# EAGLE schematic Resistor_Resistor (EAGLE 8.3.0), part 40 of 43
## Nets (continued)
N$160: R30001.2 R30002.2 R30003.2 R30004.2 R30005.2 R30006.2 R30007.2 R30008.2 R30009.2 R30010.2 R30011.2 R30012.2 R30013.2 R30014.2 R30015.2 R30016.2 R30017.2 R30018.2 R30019.2 R30020.2 R30021.2 R30022.2 R30023.2 R30024.2 R30025.2 R30026.2 R30027.2 R30028.2 R30029.2 R30030.2 R30031.2 R30032.2 R30033.2 R30034.2 R30035.2 R30036.2 R30037.2 R30038.2 R30039.2 R30040.2 R30041.2 R30042.2 R30043.2 R30044.2 R30045.2 R30046.2 R30047.2 R30048.2 R30049.2 R30050.2 R30051.2 R30052.2 R30053.2 R30054.2 R30055.2 R30056.2 R30057.2 R30058.2 R30059.2 R30060.2 R30061.2 R30062.2 R30063.2 R30064.2 R30065.2 R30066.2 R30067.2 R30068.2 R30069.2 R30070.2 R30071.2 R30072.2 R30073.2 R30074.2 R30075.2 R30076.2 R30077.2 R30078.2 R30079.2 R30080.2 R30081.2 R30082.2 R30083.2 R30084.2 R30085.2 R30086.2 R30087.2 R30088.2 R30089.2 R30090.2 R30091.2 R30092.2 R30093.2 R30094.2 R30095.2 R30096.2 R30097.2 R30098.2 R30099.2 R30100.2 R30101.2 R30102.2 R30103.2 R30104.2 R30105.2 R30106.2 R30107.2 R30108.2 R30109.2 R30110.2 R30111.2 R30112.2 R30113.2 R30114.2 R30115.2 R30116.2 R30117.2 R30118.2 R30119.2 R30120.2 R30121.2 R30122.2 R30123.2 R30124.2 R30125.2 R30126.2 R30127.2 R30128.2 R30129.2 R30130.2 R30131.2 R30132.2 R30133.2 R30134.2 R30135.2 R30136.2 R30137.2 R30138.2 R30139.2 R30140.2 R30141.2 R30142.2 R30143.2 R30144.2 R30145.2 R30146.2 R30147.2 R30148.2 R30149.2 R30150.2 R30151.2 R30152.2 R30153.2 R30154.2 R30155.2 R30156.2 R30157.2 R30158.2 R30159.2 R30160.2 R30161.2 R30162.2 R30163.2 R30164.2 R30165.2 R30166.2 R30167.2 R30168.2 R30169.2 R30170.2 R30171.2 R30172.2 R30173.2 R30174.2 R30175.2 R30176.2 R30177.2 R30178.2 R30179.2 R30180.2 R30181.2 R30182.2 R30183.2 R30184.2 R30185.2 R30186.2 R30187.2 R30188.2 R30189.2 R30190.2 R30191.2 R30192.2 R30193.2 R30194.2 R30195.2 R30196.2 R30197.2 R30198.2 R30199.2 R30200.2 R30201.1 R30202.1 R30203.1 R30204.1 R30205.1 R30206.1 R30207.1 R30208.1 R30209.1 R30210.1 R30211.1 R30212.1 R30213.1 R30214.1 R30215.1 R30216.1 R30217.1 R30218.1 R30219.1 R30220.1 R30221.1 R30222.1 R30223.1 R30224.1 R30225.1 R30226.1 R30227.1 R30228.1 R30229.1 R30230.1 R30231.1 R30232.1 R30233.1 R30234.1 R30235.1 R30236.1 R30237.1 R30238.1 R30239.1 R30240.1 R30241.1 R30242.1 R30243.1 R30244.1 R30245.1 R30246.1 R30247.1 R30248.1 R30249.1 R30250.1 R30251.1 R30252.1 R30253.1 R30254.1 R30255.1 R30256.1 R30257.1 R30258.1 R30259.1 R30260.1 R30261.1 R30262.1 R30263.1 R30264.1 R30265.1 R30266.1 R30267.1 R30268.1 R30269.1 R30270.1 R30271.1 R30272.1 R30273.1 R30274.1 R30275.1 R30276.1 R30277.1 R30278.1 R30279.1 R30280.1 R30281.1 R30282.1 R30283.1 R30284.1 R30285.1 R30286.1 R30287.1 R30288.1 R30289.1 R30290.1 R30291.1 R30292.1 R30293.1 R30294.1 R30295.1 R30296.1 R30297.1 R30298.1 R30299.1 R30300.1 R30301.1 R30302.1 R30303.1 R30304.1 R30305.1 R30306.1 R30307.1 R30308.1 R30309.1 R30310.1 R30311.1 R30312.1 R30313.1 R30314.1 R30315.1 R30316.1 R30317.1 R30318.1 R30319.1 R30320.1 R30321.1 R30322.1 R30323.1 R30324.1 R30325.1 R30326.1 R30327.1 R30328.1 R30329.1 R30330.1 R30331.1 R30332.1 R30333.1 R30334.1 R30335.1 R30336.1 R30337.1 R30338.1 R30339.1 R30340.1 R30341.1 R30342.1 R30343.1 R30344.1 R30345.1 R30346.1 R30347.1 R30348.1 R30349.1 R30350.1 R30351.1 R30352.1 R30353.1 R30354.1 R30355.1 R30356.1 R30357.1 R30358.1 R30359.1 R30360.1 R30361.1 R30362.1 R30363.1 R30364.1 R30365.1 R30366.1 R30367.1 R30368.1 R30369.1 R30370.1 R30371.1 R30372.1 R30373.1 R30374.1 R30375.1 R30376.1 R30377.1 R30378.1 R30379.1 R30380.1 R30381.1 R30382.1 R30383.1 R30384.1 R30385.1 R30386.1 R30387.1 R30388.1 R30389.1 R30390.1 R30391.1 R30392.1 R30393.1 R30394.1 R30395.1 R30396.1 R30397.1 R30398.1 R30399.1 R30400.1
N$161: R30201.2 R30202.2 R30203.2 R30204.2 R30205.2 R30206.2 R30207.2 R30208.2 R30209.2 R30210.2 R30211.2 R30212.2 R30213.2 R30214.2 R30215.2 R30216.2 R30217.2 R30218.2 R30219.2 R30220.2 R30221.2 R30222.2 R30223.2 R30224.2 R30225.2 R30226.2 R30227.2 R30228.2 R30229.2 R30230.2 R30231.2 R30232.2 R30233.2 R30234.2 R30235.2 R30236.2 R30237.2 R30238.2 R30239.2 R30240.2 R30241.2 R30242.2 R30243.2 R30244.2 R30245.2 R30246.2 R30247.2 R30248.2 R30249.2 R30250.2 R30251.2 R30252.2 R30253.2 R30254.2 R30255.2 R30256.2 R30257.2 R30258.2 R30259.2 R30260.2 R30261.2 R30262.2 R30263.2 R30264.2 R30265.2 R30266.2 R30267.2 R30268.2 R30269.2 R30270.2 R30271.2 R30272.2 R30273.2 R30274.2 R30275.2 R30276.2 R30277.2 R30278.2 R30279.2 R30280.2 R30281.2 R30282.2 R30283.2 R30284.2 R30285.2 R30286.2 R30287.2 R30288.2 R30289.2 R30290.2 R30291.2 R30292.2 R30293.2 R30294.2 R30295.2 R30296.2 R30297.2 R30298.2 R30299.2 R30300.2 R30301.2 R30302.2 R30303.2 R30304.2 R30305.2 R30306.2 R30307.2 R30308.2 R30309.2 R30310.2 R30311.2 R30312.2 R30313.2 R30314.2 R30315.2 R30316.2 R30317.2 R30318.2 R30319.2 R30320.2 R30321.2 R30322.2 R30323.2 R30324.2 R30325.2 R30326.2 R30327.2 R30328.2 R30329.2 R30330.2 R30331.2 R30332.2 R30333.2 R30334.2 R30335.2 R30336.2 R30337.2 R30338.2 R30339.2 R30340.2 R30341.2 R30342.2 R30343.2 R30344.2 R30345.2 R30346.2 R30347.2 R30348.2 R30349.2 R30350.2 R30351.2 R30352.2 R30353.2 R30354.2 R30355.2 R30356.2 R30357.2 R30358.2 R30359.2 R30360.2 R30361.2 R30362.2 R30363.2 R30364.2 R30365.2 R30366.2 R30367.2 R30368.2 R30369.2 R30370.2 R30371.2 R30372.2 R30373.2 R30374.2 R30375.2 R30376.2 R30377.2 R30378.2 R30379.2 R30380.2 R30381.2 R30382.2 R30383.2 R30384.2 R30385.2 R30386.2 R30387.2 R30388.2 R30389.2 R30390.2 R30391.2 R30392.2 R30393.2 R30394.2 R30395.2 R30396.2 R30397.2 R30398.2 R30399.2 R30400.2 R30401.1 R30402.1 R30403.1 R30404.1 R30405.1 R30406.1 R30407.1 R30408.1 R30409.1 R30410.1 R30411.1 R30412.1 R30413.1 R30414.1 R30415.1 R30416.1 R30417.1 R30418.1 R30419.1 R30420.1 R30421.1 R30422.1 R30423.1 R30424.1 R30425.1 R30426.1 R30427.1 R30428.1 R30429.1 R30430.1 R30431.1 R30432.1 R30433.1 R30434.1 R30435.1 R30436.1 R30437.1 R30438.1 R30439.1 R30440.1 R30441.1 R30442.1 R30443.1 R30444.1 R30445.1 R30446.1 R30447.1 R30448.1 R30449.1 R30450.1 R30451.1 R30452.1 R30453.1 R30454.1 R30455.1 R30456.1 R30457.1 R30458.1 R30459.1 R30460.1 R30461.1 R30462.1 R30463.1 R30464.1 R30465.1 R30466.1 R30467.1 R30468.1 R30469.1 R30470.1 R30471.1 R30472.1 R30473.1 R30474.1 R30475.1 R30476.1 R30477.1 R30478.1 R30479.1 R30480.1 R30481.1 R30482.1 R30483.1 R30484.1 R30485.1 R30486.1 R30487.1 R30488.1 R30489.1 R30490.1 R30491.1 R30492.1 R30493.1 R30494.1 R30495.1 R30496.1 R30497.1 R30498.1 R30499.1 R30500.1 R30501.1 R30502.1 R30503.1 R30504.1 R30505.1 R30506.1 R30507.1 R30508.1 R30509.1 R30510.1 R30511.1 R30512.1 R30513.1 R30514.1 R30515.1 R30516.1 R30517.1 R30518.1 R30519.1 R30520.1 R30521.1 R30522.1 R30523.1 R30524.1 R30525.1 R30526.1 R30527.1 R30528.1 R30529.1 R30530.1 R30531.1 R30532.1 R30533.1 R30534.1 R30535.1 R30536.1 R30537.1 R30538.1 R30539.1 R30540.1 R30541.1 R30542.1 R30543.1 R30544.1 R30545.1 R30546.1 R30547.1 R30548.1 R30549.1 R30550.1 R30551.1 R30552.1 R30553.1 R30554.1 R30555.1 R30556.1 R30557.1 R30558.1 R30559.1 R30560.1 R30561.1 R30562.1 R30563.1 R30564.1 R30565.1 R30566.1 R30567.1 R30568.1 R30569.1 R30570.1 R30571.1 R30572.1 R30573.1 R30574.1 R30575.1 R30576.1 R30577.1 R30578.1 R30579.1 R30580.1 R30581.1 R30582.1 R30583.1 R30584.1 R30585.1 R30586.1 R30587.1 R30588.1 R30589.1 R30590.1 R30591.1 R30592.1 R30593.1 R30594.1 R30595.1 R30596.1 R30597.1 R30598.1 R30599.1 R30600.1
N$162: R30401.2 R30402.2 R30403.2 R30404.2 R30405.2 R30406.2 R30407.2 R30408.2 R30409.2 R30410.2 R30411.2 R30412.2 R30413.2 R30414.2 R30415.2 R30416.2 R30417.2 R30418.2 R30419.2 R30420.2 R30421.2 R30422.2 R30423.2 R30424.2 R30425.2 R30426.2 R30427.2 R30428.2 R30429.2 R30430.2 R30431.2 R30432.2 R30433.2 R30434.2 R30435.2 R30436.2 R30437.2 R30438.2 R30439.2 R30440.2 R30441.2 R30442.2 R30443.2 R30444.2 R30445.2 R30446.2 R30447.2 R30448.2 R30449.2 R30450.2 R30451.2 R30452.2 R30453.2 R30454.2 R30455.2 R30456.2 R30457.2 R30458.2 R30459.2 R30460.2 R30461.2 R30462.2 R30463.2 R30464.2 R30465.2 R30466.2 R30467.2 R30468.2 R30469.2 R30470.2 R30471.2 R30472.2 R30473.2 R30474.2 R30475.2 R30476.2 R30477.2 R30478.2 R30479.2 R30480.2 R30481.2 R30482.2 R30483.2 R30484.2 R30485.2 R30486.2 R30487.2 R30488.2 R30489.2 R30490.2 R30491.2 R30492.2 R30493.2 R30494.2 R30495.2 R30496.2 R30497.2 R30498.2 R30499.2 R30500.2 R30501.2 R30502.2 R30503.2 R30504.2 R30505.2 R30506.2 R30507.2 R30508.2 R30509.2 R30510.2 R30511.2 R30512.2 R30513.2 R30514.2 R30515.2 R30516.2 R30517.2 R30518.2 R30519.2 R30520.2 R30521.2 R30522.2 R30523.2 R30524.2 R30525.2 R30526.2 R30527.2 R30528.2 R30529.2 R30530.2 R30531.2 R30532.2 R30533.2 R30534.2 R30535.2 R30536.2 R30537.2 R30538.2 R30539.2 R30540.2 R30541.2 R30542.2 R30543.2 R30544.2 R30545.2 R30546.2 R30547.2 R30548.2 R30549.2 R30550.2 R30551.2 R30552.2 R30553.2 R30554.2 R30555.2 R30556.2 R30557.2 R30558.2 R30559.2 R30560.2 R30561.2 R30562.2 R30563.2 R30564.2 R30565.2 R30566.2 R30567.2 R30568.2 R30569.2 R30570.2 R30571.2 R30572.2 R30573.2 R30574.2 R30575.2 R30576.2 R30577.2 R30578.2 R30579.2 R30580.2 R30581.2 R30582.2 R30583.2 R30584.2 R30585.2 R30586.2 R30587.2 R30588.2 R30589.2 R30590.2 R30591.2 R30592.2 R30593.2 R30594.2 R30595.2 R30596.2 R30597.2 R30598.2 R30599.2 R30600.2 R30601.1 R30602.1 R30603.1 R30604.1 R30605.1 R30606.1 R30607.1 R30608.1 R30609.1 R30610.1 R30611.1 R30612.1 R30613.1 R30614.1 R30615.1 R30616.1 R30617.1 R30618.1 R30619.1 R30620.1 R30621.1 R30622.1 R30623.1 R30624.1 R30625.1 R30626.1 R30627.1 R30628.1 R30629.1 R30630.1 R30631.1 R30632.1 R30633.1 R30634.1 R30635.1 R30636.1 R30637.1 R30638.1 R30639.1 R30640.1 R30641.1 R30642.1 R30643.1 R30644.1 R30645.1 R30646.1 R30647.1 R30648.1 R30649.1 R30650.1 R30651.1 R30652.1 R30653.1 R30654.1 R30655.1 R30656.1 R30657.1 R30658.1 R30659.1 R30660.1 R30661.1 R30662.1 R30663.1 R30664.1 R30665.1 R30666.1 R30667.1 R30668.1 R30669.1 R30670.1 R30671.1 R30672.1 R30673.1 R30674.1 R30675.1 R30676.1 R30677.1 R30678.1 R30679.1 R30680.1 R30681.1 R30682.1 R30683.1 R30684.1 R30685.1 R30686.1 R30687.1 R30688.1 R30689.1 R30690.1 R30691.1 R30692.1 R30693.1 R30694.1 R30695.1 R30696.1 R30697.1 R30698.1 R30699.1 R30700.1 R30701.1 R30702.1 R30703.1 R30704.1 R30705.1 R30706.1 R30707.1 R30708.1 R30709.1 R30710.1 R30711.1 R30712.1 R30713.1 R30714.1 R30715.1 R30716.1 R30717.1 R30718.1 R30719.1 R30720.1 R30721.1 R30722.1 R30723.1 R30724.1 R30725.1 R30726.1 R30727.1 R30728.1 R30729.1 R30730.1 R30731.1 R30732.1 R30733.1 R30734.1 R30735.1 R30736.1 R30737.1 R30738.1 R30739.1 R30740.1 R30741.1 R30742.1 R30743.1 R30744.1 R30745.1 R30746.1 R30747.1 R30748.1 R30749.1 R30750.1 R30751.1 R30752.1 R30753.1 R30754.1 R30755.1 R30756.1 R30757.1 R30758.1 R30759.1 R30760.1 R30761.1 R30762.1 R30763.1 R30764.1 R30765.1 R30766.1 R30767.1 R30768.1 R30769.1 R30770.1 R30771.1 R30772.1 R30773.1 R30774.1 R30775.1 R30776.1 R30777.1 R30778.1 R30779.1 R30780.1 R30781.1 R30782.1 R30783.1 R30784.1 R30785.1 R30786.1 R30787.1 R30788.1 R30789.1 R30790.1 R30791.1 R30792.1 R30793.1 R30794.1 R30795.1 R30796.1 R30797.1 R30798.1 R30799.1 R30800.1
N$163: R30601.2 R30602.2 R30603.2 R30604.2 R30605.2 R30606.2 R30607.2 R30608.2 R30609.2 R30610.2 R30611.2 R30612.2 R30613.2 R30614.2 R30615.2 R30616.2 R30617.2 R30618.2 R30619.2 R30620.2 R30621.2 R30622.2 R30623.2 R30624.2 R30625.2 R30626.2 R30627.2 R30628.2 R30629.2 R30630.2 R30631.2 R30632.2 R30633.2 R30634.2 R30635.2 R30636.2 R30637.2 R30638.2 R30639.2 R30640.2 R30641.2 R30642.2 R30643.2 R30644.2 R30645.2 R30646.2 R30647.2 R30648.2 R30649.2 R30650.2 R30651.2 R30652.2 R30653.2 R30654.2 R30655.2 R30656.2 R30657.2 R30658.2 R30659.2 R30660.2 R30661.2 R30662.2 R30663.2 R30664.2 R30665.2 R30666.2 R30667.2 R30668.2 R30669.2 R30670.2 R30671.2 R30672.2 R30673.2 R30674.2 R30675.2 R30676.2 R30677.2 R30678.2 R30679.2 R30680.2 R30681.2 R30682.2 R30683.2 R30684.2 R30685.2 R30686.2 R30687.2 R30688.2 R30689.2 R30690.2 R30691.2 R30692.2 R30693.2 R30694.2 R30695.2 R30696.2 R30697.2 R30698.2 R30699.2 R30700.2 R30701.2 R30702.2 R30703.2 R30704.2 R30705.2 R30706.2 R30707.2 R30708.2 R30709.2 R30710.2 R30711.2 R30712.2 R30713.2 R30714.2 R30715.2 R30716.2 R30717.2 R30718.2 R30719.2 R30720.2 R30721.2 R30722.2 R30723.2 R30724.2 R30725.2 R30726.2 R30727.2 R30728.2 R30729.2 R30730.2 R30731.2 R30732.2 R30733.2 R30734.2 R30735.2 R30736.2 R30737.2 R30738.2 R30739.2 R30740.2 R30741.2 R30742.2 R30743.2 R30744.2 R30745.2 R30746.2 R30747.2 R30748.2 R30749.2 R30750.2 R30751.2 R30752.2 R30753.2 R30754.2 R30755.2 R30756.2 R30757.2 R30758.2 R30759.2 R30760.2 R30761.2 R30762.2 R30763.2 R30764.2 R30765.2 R30766.2 R30767.2 R30768.2 R30769.2 R30770.2 R30771.2 R30772.2 R30773.2 R30774.2 R30775.2 R30776.2 R30777.2 R30778.2 R30779.2 R30780.2 R30781.2 R30782.2 R30783.2 R30784.2 R30785.2 R30786.2 R30787.2 R30788.2 R30789.2 R30790.2 R30791.2 R30792.2 R30793.2 R30794.2 R30795.2 R30796.2 R30797.2 R30798.2 R30799.2 R30800.2 R30801.1 R30802.1 R30803.1 R30804.1 R30805.1 R30806.1 R30807.1 R30808.1 R30809.1 R30810.1 R30811.1 R30812.1 R30813.1 R30814.1 R30815.1 R30816.1 R30817.1 R30818.1 R30819.1 R30820.1 R30821.1 R30822.1 R30823.1 R30824.1 R30825.1 R30826.1 R30827.1 R30828.1 R30829.1 R30830.1 R30831.1 R30832.1 R30833.1 R30834.1 R30835.1 R30836.1 R30837.1 R30838.1 R30839.1 R30840.1 R30841.1 R30842.1 R30843.1 R30844.1 R30845.1 R30846.1 R30847.1 R30848.1 R30849.1 R30850.1 R30851.1 R30852.1 R30853.1 R30854.1 R30855.1 R30856.1 R30857.1 R30858.1 R30859.1 R30860.1 R30861.1 R30862.1 R30863.1 R30864.1 R30865.1 R30866.1 R30867.1 R30868.1 R30869.1 R30870.1 R30871.1 R30872.1 R30873.1 R30874.1 R30875.1 R30876.1 R30877.1 R30878.1 R30879.1 R30880.1 R30881.1 R30882.1 R30883.1 R30884.1 R30885.1 R30886.1 R30887.1 R30888.1 R30889.1 R30890.1 R30891.1 R30892.1 R30893.1 R30894.1 R30895.1 R30896.1 R30897.1 R30898.1 R30899.1 R30900.1 R30901.1 R30902.1 R30903.1 R30904.1 R30905.1 R30906.1 R30907.1 R30908.1 R30909.1 R30910.1 R30911.1 R30912.1 R30913.1 R30914.1 R30915.1 R30916.1 R30917.1 R30918.1 R30919.1 R30920.1 R30921.1 R30922.1 R30923.1 R30924.1 R30925.1 R30926.1 R30927.1 R30928.1 R30929.1 R30930.1 R30931.1 R30932.1 R30933.1 R30934.1 R30935.1 R30936.1 R30937.1 R30938.1 R30939.1 R30940.1 R30941.1 R30942.1 R30943.1 R30944.1 R30945.1 R30946.1 R30947.1 R30948.1 R30949.1 R30950.1 R30951.1 R30952.1 R30953.1 R30954.1 R30955.1 R30956.1 R30957.1 R30958.1 R30959.1 R30960.1 R30961.1 R30962.1 R30963.1 R30964.1 R30965.1 R30966.1 R30967.1 R30968.1 R30969.1 R30970.1 R30971.1 R30972.1 R30973.1 R30974.1 R30975.1 R30976.1 R30977.1 R30978.1 R30979.1 R30980.1 R30981.1 R30982.1 R30983.1 R30984.1 R30985.1 R30986.1 R30987.1 R30988.1 R30989.1 R30990.1 R30991.1 R30992.1 R30993.1 R30994.1 R30995.1 R30996.1 R30997.1 R30998.1 R30999.1 R31000.1
N$164: R30801.2 R30802.2 R30803.2 R30804.2 R30805.2 R30806.2 R30807.2 R30808.2 R30809.2 R30810.2 R30811.2 R30812.2 R30813.2 R30814.2 R30815.2 R30816.2 R30817.2 R30818.2 R30819.2 R30820.2 R30821.2 R30822.2 R30823.2 R30824.2 R30825.2 R30826.2 R30827.2 R30828.2 R30829.2 R30830.2 R30831.2 R30832.2 R30833.2 R30834.2 R30835.2 R30836.2 R30837.2 R30838.2 R30839.2 R30840.2 R30841.2 R30842.2 R30843.2 R30844.2 R30845.2 R30846.2 R30847.2 R30848.2 R30849.2 R30850.2 R30851.2 R30852.2 R30853.2 R30854.2 R30855.2 R30856.2 R30857.2 R30858.2 R30859.2 R30860.2 R30861.2 R30862.2 R30863.2 R30864.2 R30865.2 R30866.2 R30867.2 R30868.2 R30869.2 R30870.2 R30871.2 R30872.2 R30873.2 R30874.2 R30875.2 R30876.2 R30877.2 R30878.2 R30879.2 R30880.2 R30881.2 R30882.2 R30883.2 R30884.2 R30885.2 R30886.2 R30887.2 R30888.2 R30889.2 R30890.2 R30891.2 R30892.2 R30893.2 R30894.2 R30895.2 R30896.2 R30897.2 R30898.2 R30899.2 R30900.2 R30901.2 R30902.2 R30903.2 R30904.2 R30905.2 R30906.2 R30907.2 R30908.2 R30909.2 R30910.2 R30911.2 R30912.2 R30913.2 R30914.2 R30915.2 R30916.2 R30917.2 R30918.2 R30919.2 R30920.2 R30921.2 R30922.2 R30923.2 R30924.2 R30925.2 R30926.2 R30927.2 R30928.2 R30929.2 R30930.2 R30931.2 R30932.2 R30933.2 R30934.2 R30935.2 R30936.2 R30937.2 R30938.2 R30939.2 R30940.2 R30941.2 R30942.2 R30943.2 R30944.2 R30945.2 R30946.2 R30947.2 R30948.2 R30949.2 R30950.2 R30951.2 R30952.2 R30953.2 R30954.2 R30955.2 R30956.2 R30957.2 R30958.2 R30959.2 R30960.2 R30961.2 R30962.2 R30963.2 R30964.2 R30965.2 R30966.2 R30967.2 R30968.2 R30969.2 R30970.2 R30971.2 R30972.2 R30973.2 R30974.2 R30975.2 R30976.2 R30977.2 R30978.2 R30979.2 R30980.2 R30981.2 R30982.2 R30983.2 R30984.2 R30985.2 R30986.2 R30987.2 R30988.2 R30989.2 R30990.2 R30991.2 R30992.2 R30993.2 R30994.2 R30995.2 R30996.2 R30997.2 R30998.2 R30999.2 R31000.2 R31001.1 R31002.1 R31003.1 R31004.1 R31005.1 R31006.1 R31007.1 R31008.1 R31009.1 R31010.1 R31011.1 R31012.1 R31013.1 R31014.1 R31015.1 R31016.1 R31017.1 R31018.1 R31019.1 R31020.1 R31021.1 R31022.1 R31023.1 R31024.1 R31025.1 R31026.1 R31027.1 R31028.1 R31029.1 R31030.1 R31031.1 R31032.1 R31033.1 R31034.1 R31035.1 R31036.1 R31037.1 R31038.1 R31039.1 R31040.1 R31041.1 R31042.1 R31043.1 R31044.1 R31045.1 R31046.1 R31047.1 R31048.1 R31049.1 R31050.1 R31051.1 R31052.1 R31053.1 R31054.1 R31055.1 R31056.1 R31057.1 R31058.1 R31059.1 R31060.1 R31061.1 R31062.1 R31063.1 R31064.1 R31065.1 R31066.1 R31067.1 R31068.1 R31069.1 R31070.1 R31071.1 R31072.1 R31073.1 R31074.1 R31075.1 R31076.1 R31077.1 R31078.1 R31079.1 R31080.1 R31081.1 R31082.1 R31083.1 R31084.1 R31085.1 R31086.1 R31087.1 R31088.1 R31089.1 R31090.1 R31091.1 R31092.1 R31093.1 R31094.1 R31095.1 R31096.1 R31097.1 R31098.1 R31099.1 R31100.1 R31101.1 R31102.1 R31103.1 R31104.1 R31105.1 R31106.1 R31107.1 R31108.1 R31109.1 R31110.1 R31111.1 R31112.1 R31113.1 R31114.1 R31115.1 R31116.1 R31117.1 R31118.1 R31119.1 R31120.1 R31121.1 R31122.1 R31123.1 R31124.1 R31125.1 R31126.1 R31127.1 R31128.1 R31129.1 R31130.1 R31131.1 R31132.1 R31133.1 R31134.1 R31135.1 R31136.1 R31137.1 R31138.1 R31139.1 R31140.1 R31141.1 R31142.1 R31143.1 R31144.1 R31145.1 R31146.1 R31147.1 R31148.1 R31149.1 R31150.1 R31151.1 R31152.1 R31153.1 R31154.1 R31155.1 R31156.1 R31157.1 R31158.1 R31159.1 R31160.1 R31161.1 R31162.1 R31163.1 R31164.1 R31165.1 R31166.1 R31167.1 R31168.1 R31169.1 R31170.1 R31171.1 R31172.1 R31173.1 R31174.1 R31175.1 R31176.1 R31177.1 R31178.1 R31179.1 R31180.1 R31181.1 R31182.1 R31183.1 R31184.1 R31185.1 R31186.1 R31187.1 R31188.1 R31189.1 R31190.1 R31191.1 R31192.1 R31193.1 R31194.1 R31195.1 R31196.1 R31197.1 R31198.1 R31199.1 R31200.1
N$165: R31001.2 R31002.2 R31003.2 R31004.2 R31005.2 R31006.2 R31007.2 R31008.2 R31009.2 R31010.2 R31011.2 R31012.2 R31013.2 R31014.2 R31015.2 R31016.2 R31017.2 R31018.2 R31019.2 R31020.2 R31021.2 R31022.2 R31023.2 R31024.2 R31025.2 R31026.2 R31027.2 R31028.2 R31029.2 R31030.2 R31031.2 R31032.2 R31033.2 R31034.2 R31035.2 R31036.2 R31037.2 R31038.2 R31039.2 R31040.2 R31041.2 R31042.2 R31043.2 R31044.2 R31045.2 R31046.2 R31047.2 R31048.2 R31049.2 R31050.2 R31051.2 R31052.2 R31053.2 R31054.2 R31055.2 R31056.2 R31057.2 R31058.2 R31059.2 R31060.2 R31061.2 R31062.2 R31063.2 R31064.2 R31065.2 R31066.2 R31067.2 R31068.2 R31069.2 R31070.2 R31071.2 R31072.2 R31073.2 R31074.2 R31075.2 R31076.2 R31077.2 R31078.2 R31079.2 R31080.2 R31081.2 R31082.2 R31083.2 R31084.2 R31085.2 R31086.2 R31087.2 R31088.2 R31089.2 R31090.2 R31091.2 R31092.2 R31093.2 R31094.2 R31095.2 R31096.2 R31097.2 R31098.2 R31099.2 R31100.2 R31101.2 R31102.2 R31103.2 R31104.2 R31105.2 R31106.2 R31107.2 R31108.2 R31109.2 R31110.2 R31111.2 R31112.2 R31113.2 R31114.2 R31115.2 R31116.2 R31117.2 R31118.2 R31119.2 R31120.2 R31121.2 R31122.2 R31123.2 R31124.2 R31125.2 R31126.2 R31127.2 R31128.2 R31129.2 R31130.2 R31131.2 R31132.2 R31133.2 R31134.2 R31135.2 R31136.2 R31137.2 R31138.2 R31139.2 R31140.2 R31141.2 R31142.2 R31143.2 R31144.2 R31145.2 R31146.2 R31147.2 R31148.2 R31149.2 R31150.2 R31151.2 R31152.2 R31153.2 R31154.2 R31155.2 R31156.2 R31157.2 R31158.2 R31159.2 R31160.2 R31161.2 R31162.2 R31163.2 R31164.2 R31165.2 R31166.2 R31167.2 R31168.2 R31169.2 R31170.2 R31171.2 R31172.2 R31173.2 R31174.2 R31175.2 R31176.2 R31177.2 R31178.2 R31179.2 R31180.2 R31181.2 R31182.2 R31183.2 R31184.2 R31185.2 R31186.2 R31187.2 R31188.2 R31189.2 R31190.2 R31191.2 R31192.2 R31193.2 R31194.2 R31195.2 R31196.2 R31197.2 R31198.2 R31199.2 R31200.2 R31201.1 R31202.1 R31203.1 R31204.1 R31205.1 R31206.1 R31207.1 R31208.1 R31209.1 R31210.1 R31211.1 R31212.1 R31213.1 R31214.1 R31215.1 R31216.1 R31217.1 R31218.1 R31219.1 R31220.1 R31221.1 R31222.1 R31223.1 R31224.1 R31225.1 R31226.1 R31227.1 R31228.1 R31229.1 R31230.1 R31231.1 R31232.1 R31233.1 R31234.1 R31235.1 R31236.1 R31237.1 R31238.1 R31239.1 R31240.1 R31241.1 R31242.1 R31243.1 R31244.1 R31245.1 R31246.1 R31247.1 R31248.1 R31249.1 R31250.1 R31251.1 R31252.1 R31253.1 R31254.1 R31255.1 R31256.1 R31257.1 R31258.1 R31259.1 R31260.1 R31261.1 R31262.1 R31263.1 R31264.1 R31265.1 R31266.1 R31267.1 R31268.1 R31269.1 R31270.1 R31271.1 R31272.1 R31273.1 R31274.1 R31275.1 R31276.1 R31277.1 R31278.1 R31279.1 R31280.1 R31281.1 R31282.1 R31283.1 R31284.1 R31285.1 R31286.1 R31287.1 R31288.1 R31289.1 R31290.1 R31291.1 R31292.1 R31293.1 R31294.1 R31295.1 R31296.1 R31297.1 R31298.1 R31299.1 R31300.1 R31301.1 R31302.1 R31303.1 R31304.1 R31305.1 R31306.1 R31307.1 R31308.1 R31309.1 R31310.1 R31311.1 R31312.1 R31313.1 R31314.1 R31315.1 R31316.1 R31317.1 R31318.1 R31319.1 R31320.1 R31321.1 R31322.1 R31323.1 R31324.1 R31325.1 R31326.1 R31327.1 R31328.1 R31329.1 R31330.1 R31331.1 R31332.1 R31333.1 R31334.1 R31335.1 R31336.1 R31337.1 R31338.1 R31339.1 R31340.1 R31341.1 R31342.1 R31343.1 R31344.1 R31345.1 R31346.1 R31347.1 R31348.1 R31349.1 R31350.1 R31351.1 R31352.1 R31353.1 R31354.1 R31355.1 R31356.1 R31357.1 R31358.1 R31359.1 R31360.1 R31361.1 R31362.1 R31363.1 R31364.1 R31365.1 R31366.1 R31367.1 R31368.1 R31369.1 R31370.1 R31371.1 R31372.1 R31373.1 R31374.1 R31375.1 R31376.1 R31377.1 R31378.1 R31379.1 R31380.1 R31381.1 R31382.1 R31383.1 R31384.1 R31385.1 R31386.1 R31387.1 R31388.1 R31389.1 R31390.1 R31391.1 R31392.1 R31393.1 R31394.1 R31395.1 R31396.1 R31397.1 R31398.1 R31399.1 R31400.1
N$166: R31201.2 R31202.2 R31203.2 R31204.2 R31205.2 R31206.2 R31207.2 R31208.2 R31209.2 R31210.2 R31211.2 R31212.2 R31213.2 R31214.2 R31215.2 R31216.2 R31217.2 R31218.2 R31219.2 R31220.2 R31221.2 R31222.2 R31223.2 R31224.2 R31225.2 R31226.2 R31227.2 R31228.2 R31229.2 R31230.2 R31231.2 R31232.2 R31233.2 R31234.2 R31235.2 R31236.2 R31237.2 R31238.2 R31239.2 R31240.2 R31241.2 R31242.2 R31243.2 R31244.2 R31245.2 R31246.2 R31247.2 R31248.2 R31249.2 R31250.2 R31251.2 R31252.2 R31253.2 R31254.2 R31255.2 R31256.2 R31257.2 R31258.2 R31259.2 R31260.2 R31261.2 R31262.2 R31263.2 R31264.2 R31265.2 R31266.2 R31267.2 R31268.2 R31269.2 R31270.2 R31271.2 R31272.2 R31273.2 R31274.2 R31275.2 R31276.2 R31277.2 R31278.2 R31279.2 R31280.2 R31281.2 R31282.2 R31283.2 R31284.2 R31285.2 R31286.2 R31287.2 R31288.2 R31289.2 R31290.2 R31291.2 R31292.2 R31293.2 R31294.2 R31295.2 R31296.2 R31297.2 R31298.2 R31299.2 R31300.2 R31301.2 R31302.2 R31303.2 R31304.2 R31305.2 R31306.2 R31307.2 R31308.2 R31309.2 R31310.2 R31311.2 R31312.2 R31313.2 R31314.2 R31315.2 R31316.2 R31317.2 R31318.2 R31319.2 R31320.2 R31321.2 R31322.2 R31323.2 R31324.2 R31325.2 R31326.2 R31327.2 R31328.2 R31329.2 R31330.2 R31331.2 R31332.2 R31333.2 R31334.2 R31335.2 R31336.2 R31337.2 R31338.2 R31339.2 R31340.2 R31341.2 R31342.2 R31343.2 R31344.2 R31345.2 R31346.2 R31347.2 R31348.2 R31349.2 R31350.2 R31351.2 R31352.2 R31353.2 R31354.2 R31355.2 R31356.2 R31357.2 R31358.2 R31359.2 R31360.2 R31361.2 R31362.2 R31363.2 R31364.2 R31365.2 R31366.2 R31367.2 R31368.2 R31369.2 R31370.2 R31371.2 R31372.2 R31373.2 R31374.2 R31375.2 R31376.2 R31377.2 R31378.2 R31379.2 R31380.2 R31381.2 R31382.2 R31383.2 R31384.2 R31385.2 R31386.2 R31387.2 R31388.2 R31389.2 R31390.2 R31391.2 R31392.2 R31393.2 R31394.2 R31395.2 R31396.2 R31397.2 R31398.2 R31399.2 R31400.2 R31401.1 R31402.1 R31403.1 R31404.1 R31405.1 R31406.1 R31407.1 R31408.1 R31409.1 R31410.1 R31411.1 R31412.1 R31413.1 R31414.1 R31415.1 R31416.1 R31417.1 R31418.1 R31419.1 R31420.1 R31421.1 R31422.1 R31423.1 R31424.1 R31425.1 R31426.1 R31427.1 R31428.1 R31429.1 R31430.1 R31431.1 R31432.1 R31433.1 R31434.1 R31435.1 R31436.1 R31437.1 R31438.1 R31439.1 R31440.1 R31441.1 R31442.1 R31443.1 R31444.1 R31445.1 R31446.1 R31447.1 R31448.1 R31449.1 R31450.1 R31451.1 R31452.1 R31453.1 R31454.1 R31455.1 R31456.1 R31457.1 R31458.1 R31459.1 R31460.1 R31461.1 R31462.1 R31463.1 R31464.1 R31465.1 R31466.1 R31467.1 R31468.1 R31469.1 R31470.1 R31471.1 R31472.1 R31473.1 R31474.1 R31475.1 R31476.1 R31477.1 R31478.1 R31479.1 R31480.1 R31481.1 R31482.1 R31483.1 R31484.1 R31485.1 R31486.1 R31487.1 R31488.1 R31489.1 R31490.1 R31491.1 R31492.1 R31493.1 R31494.1 R31495.1 R31496.1 R31497.1 R31498.1 R31499.1 R31500.1 R31501.1 R31502.1 R31503.1 R31504.1 R31505.1 R31506.1 R31507.1 R31508.1 R31509.1 R31510.1 R31511.1 R31512.1 R31513.1 R31514.1 R31515.1 R31516.1 R31517.1 R31518.1 R31519.1 R31520.1 R31521.1 R31522.1 R31523.1 R31524.1 R31525.1 R31526.1 R31527.1 R31528.1 R31529.1 R31530.1 R31531.1 R31532.1 R31533.1 R31534.1 R31535.1 R31536.1 R31537.1 R31538.1 R31539.1 R31540.1 R31541.1 R31542.1 R31543.1 R31544.1 R31545.1 R31546.1 R31547.1 R31548.1 R31549.1 R31550.1 R31551.1 R31552.1 R31553.1 R31554.1 R31555.1 R31556.1 R31557.1 R31558.1 R31559.1 R31560.1 R31561.1 R31562.1 R31563.1 R31564.1 R31565.1 R31566.1 R31567.1 R31568.1 R31569.1 R31570.1 R31571.1 R31572.1 R31573.1 R31574.1 R31575.1 R31576.1 R31577.1 R31578.1 R31579.1 R31580.1 R31581.1 R31582.1 R31583.1 R31584.1 R31585.1 R31586.1 R31587.1 R31588.1 R31589.1 R31590.1 R31591.1 R31592.1 R31593.1 R31594.1 R31595.1 R31596.1 R31597.1 R31598.1 R31599.1 R31600.1
N$167: R31401.2 R31402.2 R31403.2 R31404.2 R31405.2 R31406.2 R31407.2 R31408.2 R31409.2 R31410.2 R31411.2 R31412.2 R31413.2 R31414.2 R31415.2 R31416.2 R31417.2 R31418.2 R31419.2 R31420.2 R31421.2 R31422.2 R31423.2 R31424.2 R31425.2 R31426.2 R31427.2 R31428.2 R31429.2 R31430.2 R31431.2 R31432.2 R31433.2 R31434.2 R31435.2 R31436.2 R31437.2 R31438.2 R31439.2 R31440.2 R31441.2 R31442.2 R31443.2 R31444.2 R31445.2 R31446.2 R31447.2 R31448.2 R31449.2 R31450.2 R31451.2 R31452.2 R31453.2 R31454.2 R31455.2 R31456.2 R31457.2 R31458.2 R31459.2 R31460.2 R31461.2 R31462.2 R31463.2 R31464.2 R31465.2 R31466.2 R31467.2 R31468.2 R31469.2 R31470.2 R31471.2 R31472.2 R31473.2 R31474.2 R31475.2 R31476.2 R31477.2 R31478.2 R31479.2 R31480.2 R31481.2 R31482.2 R31483.2 R31484.2 R31485.2 R31486.2 R31487.2 R31488.2 R31489.2 R31490.2 R31491.2 R31492.2 R31493.2 R31494.2 R31495.2 R31496.2 R31497.2 R31498.2 R31499.2 R31500.2 R31501.2 R31502.2 R31503.2 R31504.2 R31505.2 R31506.2 R31507.2 R31508.2 R31509.2 R31510.2 R31511.2 R31512.2 R31513.2 R31514.2 R31515.2 R31516.2 R31517.2 R31518.2 R31519.2 R31520.2 R31521.2 R31522.2 R31523.2 R31524.2 R31525.2 R31526.2 R31527.2 R31528.2 R31529.2 R31530.2 R31531.2 R31532.2 R31533.2 R31534.2 R31535.2 R31536.2 R31537.2 R31538.2 R31539.2 R31540.2 R31541.2 R31542.2 R31543.2 R31544.2 R31545.2 R31546.2 R31547.2 R31548.2 R31549.2 R31550.2 R31551.2 R31552.2 R31553.2 R31554.2 R31555.2 R31556.2 R31557.2 R31558.2 R31559.2 R31560.2 R31561.2 R31562.2 R31563.2 R31564.2 R31565.2 R31566.2 R31567.2 R31568.2 R31569.2 R31570.2 R31571.2 R31572.2 R31573.2 R31574.2 R31575.2 R31576.2 R31577.2 R31578.2 R31579.2 R31580.2 R31581.2 R31582.2 R31583.2 R31584.2 R31585.2 R31586.2 R31587.2 R31588.2 R31589.2 R31590.2 R31591.2 R31592.2 R31593.2 R31594.2 R31595.2 R31596.2 R31597.2 R31598.2 R31599.2 R31600.2 R31601.1 R31602.1 R31603.1 R31604.1 R31605.1 R31606.1 R31607.1 R31608.1 R31609.1 R31610.1 R31611.1 R31612.1 R31613.1 R31614.1 R31615.1 R31616.1 R31617.1 R31618.1 R31619.1 R31620.1 R31621.1 R31622.1 R31623.1 R31624.1 R31625.1 R31626.1 R31627.1 R31628.1 R31629.1 R31630.1 R31631.1 R31632.1 R31633.1 R31634.1 R31635.1 R31636.1 R31637.1 R31638.1 R31639.1 R31640.1 R31641.1 R31642.1 R31643.1 R31644.1 R31645.1 R31646.1 R31647.1 R31648.1 R31649.1 R31650.1 R31651.1 R31652.1 R31653.1 R31654.1 R31655.1 R31656.1 R31657.1 R31658.1 R31659.1 R31660.1 R31661.1 R31662.1 R31663.1 R31664.1 R31665.1 R31666.1 R31667.1 R31668.1 R31669.1 R31670.1 R31671.1 R31672.1 R31673.1 R31674.1 R31675.1 R31676.1 R31677.1 R31678.1 R31679.1 R31680.1 R31681.1 R31682.1 R31683.1 R31684.1 R31685.1 R31686.1 R31687.1 R31688.1 R31689.1 R31690.1 R31691.1 R31692.1 R31693.1 R31694.1 R31695.1 R31696.1 R31697.1 R31698.1 R31699.1 R31700.1 R31701.1 R31702.1 R31703.1 R31704.1 R31705.1 R31706.1 R31707.1 R31708.1 R31709.1 R31710.1 R31711.1 R31712.1 R31713.1 R31714.1 R31715.1 R31716.1 R31717.1 R31718.1 R31719.1 R31720.1 R31721.1 R31722.1 R31723.1 R31724.1 R31725.1 R31726.1 R31727.1 R31728.1 R31729.1 R31730.1 R31731.1 R31732.1 R31733.1 R31734.1 R31735.1 R31736.1 R31737.1 R31738.1 R31739.1 R31740.1 R31741.1 R31742.1 R31743.1 R31744.1 R31745.1 R31746.1 R31747.1 R31748.1 R31749.1 R31750.1 R31751.1 R31752.1 R31753.1 R31754.1 R31755.1 R31756.1 R31757.1 R31758.1 R31759.1 R31760.1 R31761.1 R31762.1 R31763.1 R31764.1 R31765.1 R31766.1 R31767.1 R31768.1 R31769.1 R31770.1 R31771.1 R31772.1 R31773.1 R31774.1 R31775.1 R31776.1 R31777.1 R31778.1 R31779.1 R31780.1 R31781.1 R31782.1 R31783.1 R31784.1 R31785.1 R31786.1 R31787.1 R31788.1 R31789.1 R31790.1 R31791.1 R31792.1 R31793.1 R31794.1 R31795.1 R31796.1 R31797.1 R31798.1 R31799.1 R31800.1
N$168: R31601.2 R31602.2 R31603.2 R31604.2 R31605.2 R31606.2 R31607.2 R31608.2 R31609.2 R31610.2 R31611.2 R31612.2 R31613.2 R31614.2 R31615.2 R31616.2 R31617.2 R31618.2 R31619.2 R31620.2 R31621.2 R31622.2 R31623.2 R31624.2 R31625.2 R31626.2 R31627.2 R31628.2 R31629.2 R31630.2 R31631.2 R31632.2 R31633.2 R31634.2 R31635.2 R31636.2 R31637.2 R31638.2 R31639.2 R31640.2 R31641.2 R31642.2 R31643.2 R31644.2 R31645.2 R31646.2 R31647.2 R31648.2 R31649.2 R31650.2 R31651.2 R31652.2 R31653.2 R31654.2 R31655.2 R31656.2 R31657.2 R31658.2 R31659.2 R31660.2 R31661.2 R31662.2 R31663.2 R31664.2 R31665.2 R31666.2 R31667.2 R31668.2 R31669.2 R31670.2 R31671.2 R31672.2 R31673.2 R31674.2 R31675.2 R31676.2 R31677.2 R31678.2 R31679.2 R31680.2 R31681.2 R31682.2 R31683.2 R31684.2 R31685.2 R31686.2 R31687.2 R31688.2 R31689.2 R31690.2 R31691.2 R31692.2 R31693.2 R31694.2 R31695.2 R31696.2 R31697.2 R31698.2 R31699.2 R31700.2 R31701.2 R31702.2 R31703.2 R31704.2 R31705.2 R31706.2 R31707.2 R31708.2 R31709.2 R31710.2 R31711.2 R31712.2 R31713.2 R31714.2 R31715.2 R31716.2 R31717.2 R31718.2 R31719.2 R31720.2 R31721.2 R31722.2 R31723.2 R31724.2 R31725.2 R31726.2 R31727.2 R31728.2 R31729.2 R31730.2 R31731.2 R31732.2 R31733.2 R31734.2 R31735.2 R31736.2 R31737.2 R31738.2 R31739.2 R31740.2 R31741.2 R31742.2 R31743.2 R31744.2 R31745.2 R31746.2 R31747.2 R31748.2 R31749.2 R31750.2 R31751.2 R31752.2 R31753.2 R31754.2 R31755.2 R31756.2 R31757.2 R31758.2 R31759.2 R31760.2 R31761.2 R31762.2 R31763.2 R31764.2 R31765.2 R31766.2 R31767.2 R31768.2 R31769.2 R31770.2 R31771.2 R31772.2 R31773.2 R31774.2 R31775.2 R31776.2 R31777.2 R31778.2 R31779.2 R31780.2 R31781.2 R31782.2 R31783.2 R31784.2 R31785.2 R31786.2 R31787.2 R31788.2 R31789.2 R31790.2 R31791.2 R31792.2 R31793.2 R31794.2 R31795.2 R31796.2 R31797.2 R31798.2 R31799.2 R31800.2 R31801.1 R31802.1 R31803.1 R31804.1 R31805.1 R31806.1 R31807.1 R31808.1 R31809.1 R31810.1 R31811.1 R31812.1 R31813.1 R31814.1 R31815.1 R31816.1 R31817.1 R31818.1 R31819.1 R31820.1 R31821.1 R31822.1 R31823.1 R31824.1 R31825.1 R31826.1 R31827.1 R31828.1 R31829.1 R31830.1 R31831.1 R31832.1 R31833.1 R31834.1 R31835.1 R31836.1 R31837.1 R31838.1 R31839.1 R31840.1 R31841.1 R31842.1 R31843.1 R31844.1 R31845.1 R31846.1 R31847.1 R31848.1 R31849.1 R31850.1 R31851.1 R31852.1 R31853.1 R31854.1 R31855.1 R31856.1 R31857.1 R31858.1 R31859.1 R31860.1 R31861.1 R31862.1 R31863.1 R31864.1 R31865.1 R31866.1 R31867.1 R31868.1 R31869.1 R31870.1 R31871.1 R31872.1 R31873.1 R31874.1 R31875.1 R31876.1 R31877.1 R31878.1 R31879.1 R31880.1 R31881.1 R31882.1 R31883.1 R31884.1 R31885.1 R31886.1 R31887.1 R31888.1 R31889.1 R31890.1 R31891.1 R31892.1 R31893.1 R31894.1 R31895.1 R31896.1 R31897.1 R31898.1 R31899.1 R31900.1 R31901.1 R31902.1 R31903.1 R31904.1 R31905.1 R31906.1 R31907.1 R31908.1 R31909.1 R31910.1 R31911.1 R31912.1 R31913.1 R31914.1 R31915.1 R31916.1 R31917.1 R31918.1 R31919.1 R31920.1 R31921.1 R31922.1 R31923.1 R31924.1 R31925.1 R31926.1 R31927.1 R31928.1 R31929.1 R31930.1 R31931.1 R31932.1 R31933.1 R31934.1 R31935.1 R31936.1 R31937.1 R31938.1 R31939.1 R31940.1 R31941.1 R31942.1 R31943.1 R31944.1 R31945.1 R31946.1 R31947.1 R31948.1 R31949.1 R31950.1 R31951.1 R31952.1 R31953.1 R31954.1 R31955.1 R31956.1 R31957.1 R31958.1 R31959.1 R31960.1 R31961.1 R31962.1 R31963.1 R31964.1 R31965.1 R31966.1 R31967.1 R31968.1 R31969.1 R31970.1 R31971.1 R31972.1 R31973.1 R31974.1 R31975.1 R31976.1 R31977.1 R31978.1 R31979.1 R31980.1 R31981.1 R31982.1 R31983.1 R31984.1 R31985.1 R31986.1 R31987.1 R31988.1 R31989.1 R31990.1 R31991.1 R31992.1 R31993.1 R31994.1 R31995.1 R31996.1 R31997.1 R31998.1 R31999.1 R32000.1
N$169: R31801.2 R31802.2 R31803.2 R31804.2 R31805.2 R31806.2 R31807.2 R31808.2 R31809.2 R31810.2 R31811.2 R31812.2 R31813.2 R31814.2 R31815.2 R31816.2 R31817.2 R31818.2 R31819.2 R31820.2 R31821.2 R31822.2 R31823.2 R31824.2 R31825.2 R31826.2 R31827.2 R31828.2 R31829.2 R31830.2 R31831.2 R31832.2 R31833.2 R31834.2 R31835.2 R31836.2 R31837.2 R31838.2 R31839.2 R31840.2 R31841.2 R31842.2 R31843.2 R31844.2 R31845.2 R31846.2 R31847.2 R31848.2 R31849.2 R31850.2 R31851.2 R31852.2 R31853.2 R31854.2 R31855.2 R31856.2 R31857.2 R31858.2 R31859.2 R31860.2 R31861.2 R31862.2 R31863.2 R31864.2 R31865.2 R31866.2 R31867.2 R31868.2 R31869.2 R31870.2 R31871.2 R31872.2 R31873.2 R31874.2 R31875.2 R31876.2 R31877.2 R31878.2 R31879.2 R31880.2 R31881.2 R31882.2 R31883.2 R31884.2 R31885.2 R31886.2 R31887.2 R31888.2 R31889.2 R31890.2 R31891.2 R31892.2 R31893.2 R31894.2 R31895.2 R31896.2 R31897.2 R31898.2 R31899.2 R31900.2 R31901.2 R31902.2 R31903.2 R31904.2 R31905.2 R31906.2 R31907.2 R31908.2 R31909.2 R31910.2 R31911.2 R31912.2 R31913.2 R31914.2 R31915.2 R31916.2 R31917.2 R31918.2 R31919.2 R31920.2 R31921.2 R31922.2 R31923.2 R31924.2 R31925.2 R31926.2 R31927.2 R31928.2 R31929.2 R31930.2 R31931.2 R31932.2 R31933.2 R31934.2 R31935.2 R31936.2 R31937.2 R31938.2 R31939.2 R31940.2 R31941.2 R31942.2 R31943.2 R31944.2 R31945.2 R31946.2 R31947.2 R31948.2 R31949.2 R31950.2 R31951.2 R31952.2 R31953.2 R31954.2 R31955.2 R31956.2 R31957.2 R31958.2 R31959.2 R31960.2 R31961.2 R31962.2 R31963.2 R31964.2 R31965.2 R31966.2 R31967.2 R31968.2 R31969.2 R31970.2 R31971.2 R31972.2 R31973.2 R31974.2 R31975.2 R31976.2 R31977.2 R31978.2 R31979.2 R31980.2 R31981.2 R31982.2 R31983.2 R31984.2 R31985.2 R31986.2 R31987.2 R31988.2 R31989.2 R31990.2 R31991.2 R31992.2 R31993.2 R31994.2 R31995.2 R31996.2 R31997.2 R31998.2 R31999.2 R32000.2 R32001.1 R32002.1 R32003.1 R32004.1 R32005.1 R32006.1 R32007.1 R32008.1 R32009.1 R32010.1 R32011.1 R32012.1 R32013.1 R32014.1 R32015.1 R32016.1 R32017.1 R32018.1 R32019.1 R32020.1 R32021.1 R32022.1 R32023.1 R32024.1 R32025.1 R32026.1 R32027.1 R32028.1 R32029.1 R32030.1 R32031.1 R32032.1 R32033.1 R32034.1 R32035.1 R32036.1 R32037.1 R32038.1 R32039.1 R32040.1 R32041.1 R32042.1 R32043.1 R32044.1 R32045.1 R32046.1 R32047.1 R32048.1 R32049.1 R32050.1 R32051.1 R32052.1 R32053.1 R32054.1 R32055.1 R32056.1 R32057.1 R32058.1 R32059.1 R32060.1 R32061.1 R32062.1 R32063.1 R32064.1 R32065.1 R32066.1 R32067.1 R32068.1 R32069.1 R32070.1 R32071.1 R32072.1 R32073.1 R32074.1 R32075.1 R32076.1 R32077.1 R32078.1 R32079.1 R32080.1 R32081.1 R32082.1 R32083.1 R32084.1 R32085.1 R32086.1 R32087.1 R32088.1 R32089.1 R32090.1 R32091.1 R32092.1 R32093.1 R32094.1 R32095.1 R32096.1 R32097.1 R32098.1 R32099.1 R32100.1 R32101.1 R32102.1 R32103.1 R32104.1 R32105.1 R32106.1 R32107.1 R32108.1 R32109.1 R32110.1 R32111.1 R32112.1 R32113.1 R32114.1 R32115.1 R32116.1 R32117.1 R32118.1 R32119.1 R32120.1 R32121.1 R32122.1 R32123.1 R32124.1 R32125.1 R32126.1 R32127.1 R32128.1 R32129.1 R32130.1 R32131.1 R32132.1 R32133.1 R32134.1 R32135.1 R32136.1 R32137.1 R32138.1 R32139.1 R32140.1 R32141.1 R32142.1 R32143.1 R32144.1 R32145.1 R32146.1 R32147.1 R32148.1 R32149.1 R32150.1 R32151.1 R32152.1 R32153.1 R32154.1 R32155.1 R32156.1 R32157.1 R32158.1 R32159.1 R32160.1 R32161.1 R32162.1 R32163.1 R32164.1 R32165.1 R32166.1 R32167.1 R32168.1 R32169.1 R32170.1 R32171.1 R32172.1 R32173.1 R32174.1 R32175.1 R32176.1 R32177.1 R32178.1 R32179.1 R32180.1 R32181.1 R32182.1 R32183.1 R32184.1 R32185.1 R32186.1 R32187.1 R32188.1 R32189.1 R32190.1 R32191.1 R32192.1 R32193.1 R32194.1 R32195.1 R32196.1 R32197.1 R32198.1 R32199.1 R32200.1
N$170: R32001.2 R32002.2 R32003.2 R32004.2 R32005.2 R32006.2 R32007.2 R32008.2 R32009.2 R32010.2 R32011.2 R32012.2 R32013.2 R32014.2 R32015.2 R32016.2 R32017.2 R32018.2 R32019.2 R32020.2 R32021.2 R32022.2 R32023.2 R32024.2 R32025.2 R32026.2 R32027.2 R32028.2 R32029.2 R32030.2 R32031.2 R32032.2 R32033.2 R32034.2 R32035.2 R32036.2 R32037.2 R32038.2 R32039.2 R32040.2 R32041.2 R32042.2 R32043.2 R32044.2 R32045.2 R32046.2 R32047.2 R32048.2 R32049.2 R32050.2 R32051.2 R32052.2 R32053.2 R32054.2 R32055.2 R32056.2 R32057.2 R32058.2 R32059.2 R32060.2 R32061.2 R32062.2 R32063.2 R32064.2 R32065.2 R32066.2 R32067.2 R32068.2 R32069.2 R32070.2 R32071.2 R32072.2 R32073.2 R32074.2 R32075.2 R32076.2 R32077.2 R32078.2 R32079.2 R32080.2 R32081.2 R32082.2 R32083.2 R32084.2 R32085.2 R32086.2 R32087.2 R32088.2 R32089.2 R32090.2 R32091.2 R32092.2 R32093.2 R32094.2 R32095.2 R32096.2 R32097.2 R32098.2 R32099.2 R32100.2 R32101.2 R32102.2 R32103.2 R32104.2 R32105.2 R32106.2 R32107.2 R32108.2 R32109.2 R32110.2 R32111.2 R32112.2 R32113.2 R32114.2 R32115.2 R32116.2 R32117.2 R32118.2 R32119.2 R32120.2 R32121.2 R32122.2 R32123.2 R32124.2 R32125.2 R32126.2 R32127.2 R32128.2 R32129.2 R32130.2 R32131.2 R32132.2 R32133.2 R32134.2 R32135.2 R32136.2 R32137.2 R32138.2 R32139.2 R32140.2 R32141.2 R32142.2 R32143.2 R32144.2 R32145.2 R32146.2 R32147.2 R32148.2 R32149.2 R32150.2 R32151.2 R32152.2 R32153.2 R32154.2 R32155.2 R32156.2 R32157.2 R32158.2 R32159.2 R32160.2 R32161.2 R32162.2 R32163.2 R32164.2 R32165.2 R32166.2 R32167.2 R32168.2 R32169.2 R32170.2 R32171.2 R32172.2 R32173.2 R32174.2 R32175.2 R32176.2 R32177.2 R32178.2 R32179.2 R32180.2 R32181.2 R32182.2 R32183.2 R32184.2 R32185.2 R32186.2 R32187.2 R32188.2 R32189.2 R32190.2 R32191.2 R32192.2 R32193.2 R32194.2 R32195.2 R32196.2 R32197.2 R32198.2 R32199.2 R32200.2 R32201.1 R32202.1 R32203.1 R32204.1 R32205.1 R32206.1 R32207.1 R32208.1 R32209.1 R32210.1 R32211.1 R32212.1 R32213.1 R32214.1 R32215.1 R32216.1 R32217.1 R32218.1 R32219.1 R32220.1 R32221.1 R32222.1 R32223.1 R32224.1 R32225.1 R32226.1 R32227.1 R32228.1 R32229.1 R32230.1 R32231.1 R32232.1 R32233.1 R32234.1 R32235.1 R32236.1 R32237.1 R32238.1 R32239.1 R32240.1 R32241.1 R32242.1 R32243.1 R32244.1 R32245.1 R32246.1 R32247.1 R32248.1 R32249.1 R32250.1 R32251.1 R32252.1 R32253.1 R32254.1 R32255.1 R32256.1 R32257.1 R32258.1 R32259.1 R32260.1 R32261.1 R32262.1 R32263.1 R32264.1 R32265.1 R32266.1 R32267.1 R32268.1 R32269.1 R32270.1 R32271.1 R32272.1 R32273.1 R32274.1 R32275.1 R32276.1 R32277.1 R32278.1 R32279.1 R32280.1 R32281.1 R32282.1 R32283.1 R32284.1 R32285.1 R32286.1 R32287.1 R32288.1 R32289.1 R32290.1 R32291.1 R32292.1 R32293.1 R32294.1 R32295.1 R32296.1 R32297.1 R32298.1 R32299.1 R32300.1 R32301.1 R32302.1 R32303.1 R32304.1 R32305.1 R32306.1 R32307.1 R32308.1 R32309.1 R32310.1 R32311.1 R32312.1 R32313.1 R32314.1 R32315.1 R32316.1 R32317.1 R32318.1 R32319.1 R32320.1 R32321.1 R32322.1 R32323.1 R32324.1 R32325.1 R32326.1 R32327.1 R32328.1 R32329.1 R32330.1 R32331.1 R32332.1 R32333.1 R32334.1 R32335.1 R32336.1 R32337.1 R32338.1 R32339.1 R32340.1 R32341.1 R32342.1 R32343.1 R32344.1 R32345.1 R32346.1 R32347.1 R32348.1 R32349.1 R32350.1 R32351.1 R32352.1 R32353.1 R32354.1 R32355.1 R32356.1 R32357.1 R32358.1 R32359.1 R32360.1 R32361.1 R32362.1 R32363.1 R32364.1 R32365.1 R32366.1 R32367.1 R32368.1 R32369.1 R32370.1 R32371.1 R32372.1 R32373.1 R32374.1 R32375.1 R32376.1 R32377.1 R32378.1 R32379.1 R32380.1 R32381.1 R32382.1 R32383.1 R32384.1 R32385.1 R32386.1 R32387.1 R32388.1 R32389.1 R32390.1 R32391.1 R32392.1 R32393.1 R32394.1 R32395.1 R32396.1 R32397.1 R32398.1 R32399.1 R32400.1
N$171: R32201.2 R32202.2 R32203.2 R32204.2 R32205.2 R32206.2 R32207.2 R32208.2 R32209.2 R32210.2 R32211.2 R32212.2 R32213.2 R32214.2 R32215.2 R32216.2 R32217.2 R32218.2 R32219.2 R32220.2 R32221.2 R32222.2 R32223.2 R32224.2 R32225.2 R32226.2 R32227.2 R32228.2 R32229.2 R32230.2 R32231.2 R32232.2 R32233.2 R32234.2 R32235.2 R32236.2 R32237.2 R32238.2 R32239.2 R32240.2 R32241.2 R32242.2 R32243.2 R32244.2 R32245.2 R32246.2 R32247.2 R32248.2 R32249.2 R32250.2 R32251.2 R32252.2 R32253.2 R32254.2 R32255.2 R32256.2 R32257.2 R32258.2 R32259.2 R32260.2 R32261.2 R32262.2 R32263.2 R32264.2 R32265.2 R32266.2 R32267.2 R32268.2 R32269.2 R32270.2 R32271.2 R32272.2 R32273.2 R32274.2 R32275.2 R32276.2 R32277.2 R32278.2 R32279.2 R32280.2 R32281.2 R32282.2 R32283.2 R32284.2 R32285.2 R32286.2 R32287.2 R32288.2 R32289.2 R32290.2 R32291.2 R32292.2 R32293.2 R32294.2 R32295.2 R32296.2 R32297.2 R32298.2 R32299.2 R32300.2 R32301.2 R32302.2 R32303.2 R32304.2 R32305.2 R32306.2 R32307.2 R32308.2 R32309.2 R32310.2 R32311.2 R32312.2 R32313.2 R32314.2 R32315.2 R32316.2 R32317.2 R32318.2 R32319.2 R32320.2 R32321.2 R32322.2 R32323.2 R32324.2 R32325.2 R32326.2 R32327.2 R32328.2 R32329.2 R32330.2 R32331.2 R32332.2 R32333.2 R32334.2 R32335.2 R32336.2 R32337.2 R32338.2 R32339.2 R32340.2 R32341.2 R32342.2 R32343.2 R32344.2 R32345.2 R32346.2 R32347.2 R32348.2 R32349.2 R32350.2 R32351.2 R32352.2 R32353.2 R32354.2 R32355.2 R32356.2 R32357.2 R32358.2 R32359.2 R32360.2 R32361.2 R32362.2 R32363.2 R32364.2 R32365.2 R32366.2 R32367.2 R32368.2 R32369.2 R32370.2 R32371.2 R32372.2 R32373.2 R32374.2 R32375.2 R32376.2 R32377.2 R32378.2 R32379.2 R32380.2 R32381.2 R32382.2 R32383.2 R32384.2 R32385.2 R32386.2 R32387.2 R32388.2 R32389.2 R32390.2 R32391.2 R32392.2 R32393.2 R32394.2 R32395.2 R32396.2 R32397.2 R32398.2 R32399.2 R32400.2 R32401.1 R32402.1 R32403.1 R32404.1 R32405.1 R32406.1 R32407.1 R32408.1 R32409.1 R32410.1 R32411.1 R32412.1 R32413.1 R32414.1 R32415.1 R32416.1 R32417.1 R32418.1 R32419.1 R32420.1 R32421.1 R32422.1 R32423.1 R32424.1 R32425.1 R32426.1 R32427.1 R32428.1 R32429.1 R32430.1 R32431.1 R32432.1 R32433.1 R32434.1 R32435.1 R32436.1 R32437.1 R32438.1 R32439.1 R32440.1 R32441.1 R32442.1 R32443.1 R32444.1 R32445.1 R32446.1 R32447.1 R32448.1 R32449.1 R32450.1 R32451.1 R32452.1 R32453.1 R32454.1 R32455.1 R32456.1 R32457.1 R32458.1 R32459.1 R32460.1 R32461.1 R32462.1 R32463.1 R32464.1 R32465.1 R32466.1 R32467.1 R32468.1 R32469.1 R32470.1 R32471.1 R32472.1 R32473.1 R32474.1 R32475.1 R32476.1 R32477.1 R32478.1 R32479.1 R32480.1 R32481.1 R32482.1 R32483.1 R32484.1 R32485.1 R32486.1 R32487.1 R32488.1 R32489.1 R32490.1 R32491.1 R32492.1 R32493.1 R32494.1 R32495.1 R32496.1 R32497.1 R32498.1 R32499.1 R32500.1 R32501.1 R32502.1 R32503.1 R32504.1 R32505.1 R32506.1 R32507.1 R32508.1 R32509.1 R32510.1 R32511.1 R32512.1 R32513.1 R32514.1 R32515.1 R32516.1 R32517.1 R32518.1 R32519.1 R32520.1 R32521.1 R32522.1 R32523.1 R32524.1 R32525.1 R32526.1 R32527.1 R32528.1 R32529.1 R32530.1 R32531.1 R32532.1 R32533.1 R32534.1 R32535.1 R32536.1 R32537.1 R32538.1 R32539.1 R32540.1 R32541.1 R32542.1 R32543.1 R32544.1 R32545.1 R32546.1 R32547.1 R32548.1 R32549.1 R32550.1 R32551.1 R32552.1 R32553.1 R32554.1 R32555.1 R32556.1 R32557.1 R32558.1 R32559.1 R32560.1 R32561.1 R32562.1 R32563.1 R32564.1 R32565.1 R32566.1 R32567.1 R32568.1 R32569.1 R32570.1 R32571.1 R32572.1 R32573.1 R32574.1 R32575.1 R32576.1 R32577.1 R32578.1 R32579.1 R32580.1 R32581.1 R32582.1 R32583.1 R32584.1 R32585.1 R32586.1 R32587.1 R32588.1 R32589.1 R32590.1 R32591.1 R32592.1 R32593.1 R32594.1 R32595.1 R32596.1 R32597.1 R32598.1 R32599.1 R32600.1
N$172: R32401.2 R32402.2 R32403.2 R32404.2 R32405.2 R32406.2 R32407.2 R32408.2 R32409.2 R32410.2 R32411.2 R32412.2 R32413.2 R32414.2 R32415.2 R32416.2 R32417.2 R32418.2 R32419.2 R32420.2 R32421.2 R32422.2 R32423.2 R32424.2 R32425.2 R32426.2 R32427.2 R32428.2 R32429.2 R32430.2 R32431.2 R32432.2 R32433.2 R32434.2 R32435.2 R32436.2 R32437.2 R32438.2 R32439.2 R32440.2 R32441.2 R32442.2 R32443.2 R32444.2 R32445.2 R32446.2 R32447.2 R32448.2 R32449.2 R32450.2 R32451.2 R32452.2 R32453.2 R32454.2 R32455.2 R32456.2 R32457.2 R32458.2 R32459.2 R32460.2 R32461.2 R32462.2 R32463.2 R32464.2 R32465.2 R32466.2 R32467.2 R32468.2 R32469.2 R32470.2 R32471.2 R32472.2 R32473.2 R32474.2 R32475.2 R32476.2 R32477.2 R32478.2 R32479.2 R32480.2 R32481.2 R32482.2 R32483.2 R32484.2 R32485.2 R32486.2 R32487.2 R32488.2 R32489.2 R32490.2 R32491.2 R32492.2 R32493.2 R32494.2 R32495.2 R32496.2 R32497.2 R32498.2 R32499.2 R32500.2 R32501.2 R32502.2 R32503.2 R32504.2 R32505.2 R32506.2 R32507.2 R32508.2 R32509.2 R32510.2 R32511.2 R32512.2 R32513.2 R32514.2 R32515.2 R32516.2 R32517.2 R32518.2 R32519.2 R32520.2 R32521.2 R32522.2 R32523.2 R32524.2 R32525.2 R32526.2 R32527.2 R32528.2 R32529.2 R32530.2 R32531.2 R32532.2 R32533.2 R32534.2 R32535.2 R32536.2 R32537.2 R32538.2 R32539.2 R32540.2 R32541.2 R32542.2 R32543.2 R32544.2 R32545.2 R32546.2 R32547.2 R32548.2 R32549.2 R32550.2 R32551.2 R32552.2 R32553.2 R32554.2 R32555.2 R32556.2 R32557.2 R32558.2 R32559.2 R32560.2 R32561.2 R32562.2 R32563.2 R32564.2 R32565.2 R32566.2 R32567.2 R32568.2 R32569.2 R32570.2 R32571.2 R32572.2 R32573.2 R32574.2 R32575.2 R32576.2 R32577.2 R32578.2 R32579.2 R32580.2 R32581.2 R32582.2 R32583.2 R32584.2 R32585.2 R32586.2 R32587.2 R32588.2 R32589.2 R32590.2 R32591.2 R32592.2 R32593.2 R32594.2 R32595.2 R32596.2 R32597.2 R32598.2 R32599.2 R32600.2 R32601.1 R32602.1 R32603.1 R32604.1 R32605.1 R32606.1 R32607.1 R32608.1 R32609.1 R32610.1 R32611.1 R32612.1 R32613.1 R32614.1 R32615.1 R32616.1 R32617.1 R32618.1 R32619.1 R32620.1 R32621.1 R32622.1 R32623.1 R32624.1 R32625.1 R32626.1 R32627.1 R32628.1 R32629.1 R32630.1 R32631.1 R32632.1 R32633.1 R32634.1 R32635.1 R32636.1 R32637.1 R32638.1 R32639.1 R32640.1 R32641.1 R32642.1 R32643.1 R32644.1 R32645.1 R32646.1 R32647.1 R32648.1 R32649.1 R32650.1 R32651.1 R32652.1 R32653.1 R32654.1 R32655.1 R32656.1 R32657.1 R32658.1 R32659.1 R32660.1 R32661.1 R32662.1 R32663.1 R32664.1 R32665.1 R32666.1 R32667.1 R32668.1 R32669.1 R32670.1 R32671.1 R32672.1 R32673.1 R32674.1 R32675.1 R32676.1 R32677.1 R32678.1 R32679.1 R32680.1 R32681.1 R32682.1 R32683.1 R32684.1 R32685.1 R32686.1 R32687.1 R32688.1 R32689.1 R32690.1 R32691.1 R32692.1 R32693.1 R32694.1 R32695.1 R32696.1 R32697.1 R32698.1 R32699.1 R32700.1 R32701.1 R32702.1 R32703.1 R32704.1 R32705.1 R32706.1 R32707.1 R32708.1 R32709.1 R32710.1 R32711.1 R32712.1 R32713.1 R32714.1 R32715.1 R32716.1 R32717.1 R32718.1 R32719.1 R32720.1 R32721.1 R32722.1 R32723.1 R32724.1 R32725.1 R32726.1 R32727.1 R32728.1 R32729.1 R32730.1 R32731.1 R32732.1 R32733.1 R32734.1 R32735.1 R32736.1 R32737.1 R32738.1 R32739.1 R32740.1 R32741.1 R32742.1 R32743.1 R32744.1 R32745.1 R32746.1 R32747.1 R32748.1 R32749.1 R32750.1 R32751.1 R32752.1 R32753.1 R32754.1 R32755.1 R32756.1 R32757.1 R32758.1 R32759.1 R32760.1 R32761.1 R32762.1 R32763.1 R32764.1 R32765.1 R32766.1 R32767.1 R32768.1 R32769.1 R32770.1 R32771.1 R32772.1 R32773.1 R32774.1 R32775.1 R32776.1 R32777.1 R32778.1 R32779.1 R32780.1 R32781.1 R32782.1 R32783.1 R32784.1 R32785.1 R32786.1 R32787.1 R32788.1 R32789.1 R32790.1 R32791.1 R32792.1 R32793.1 R32794.1 R32795.1 R32796.1 R32797.1 R32798.1 R32799.1 R32800.1